# EasyEDA Pro project 第十五届蓝桥杯EDA赛模拟试题二参考答案.eprj, board PCB-PockerMultimater1
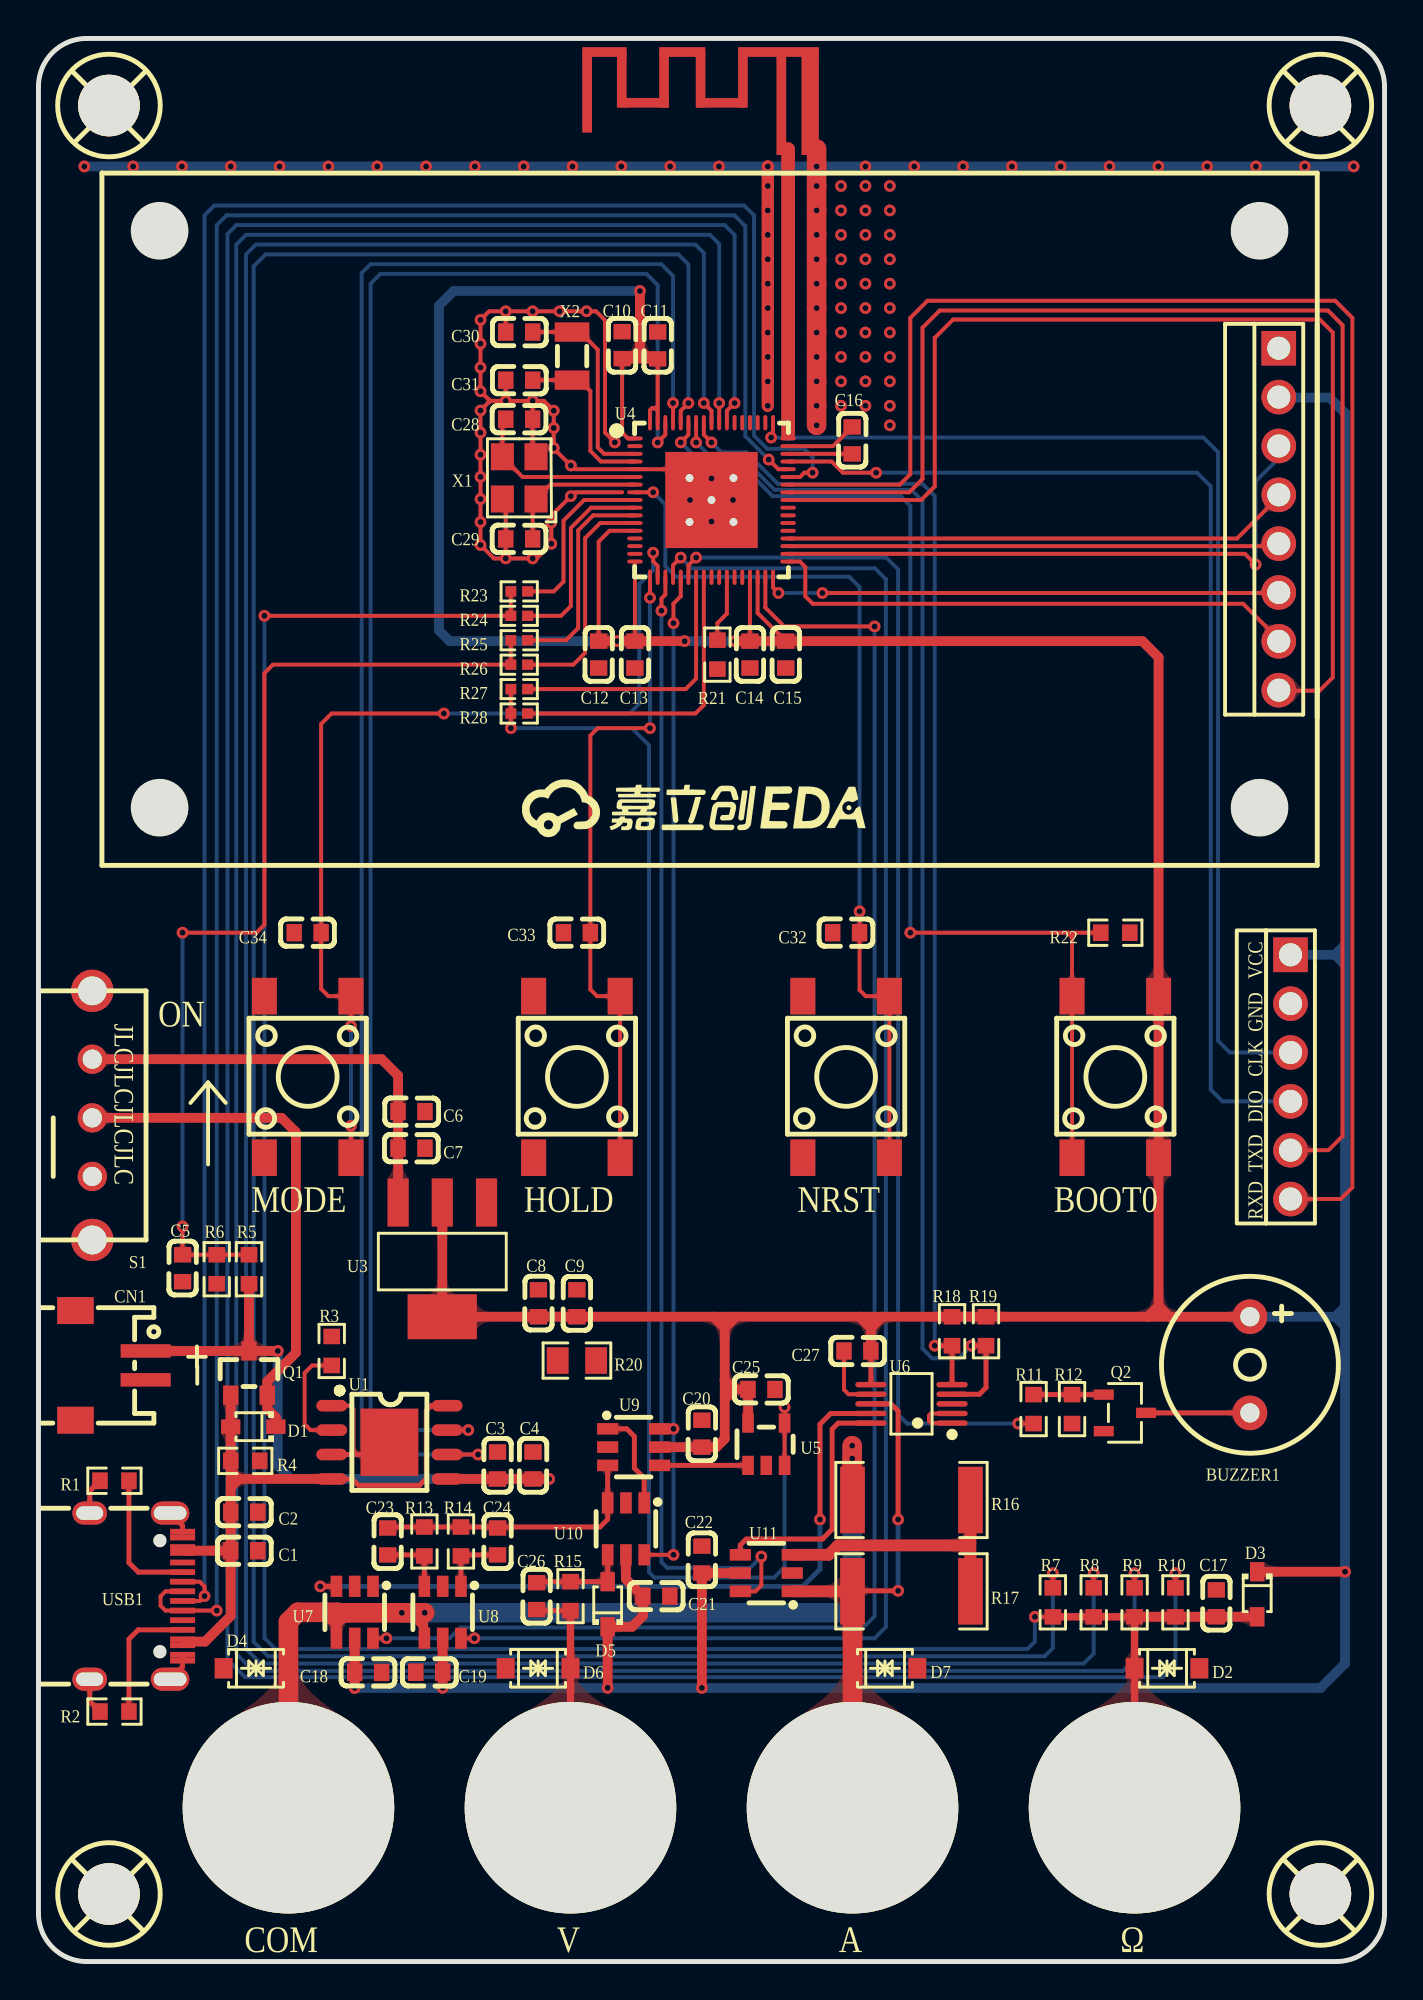
[diagram p1: board, top side]
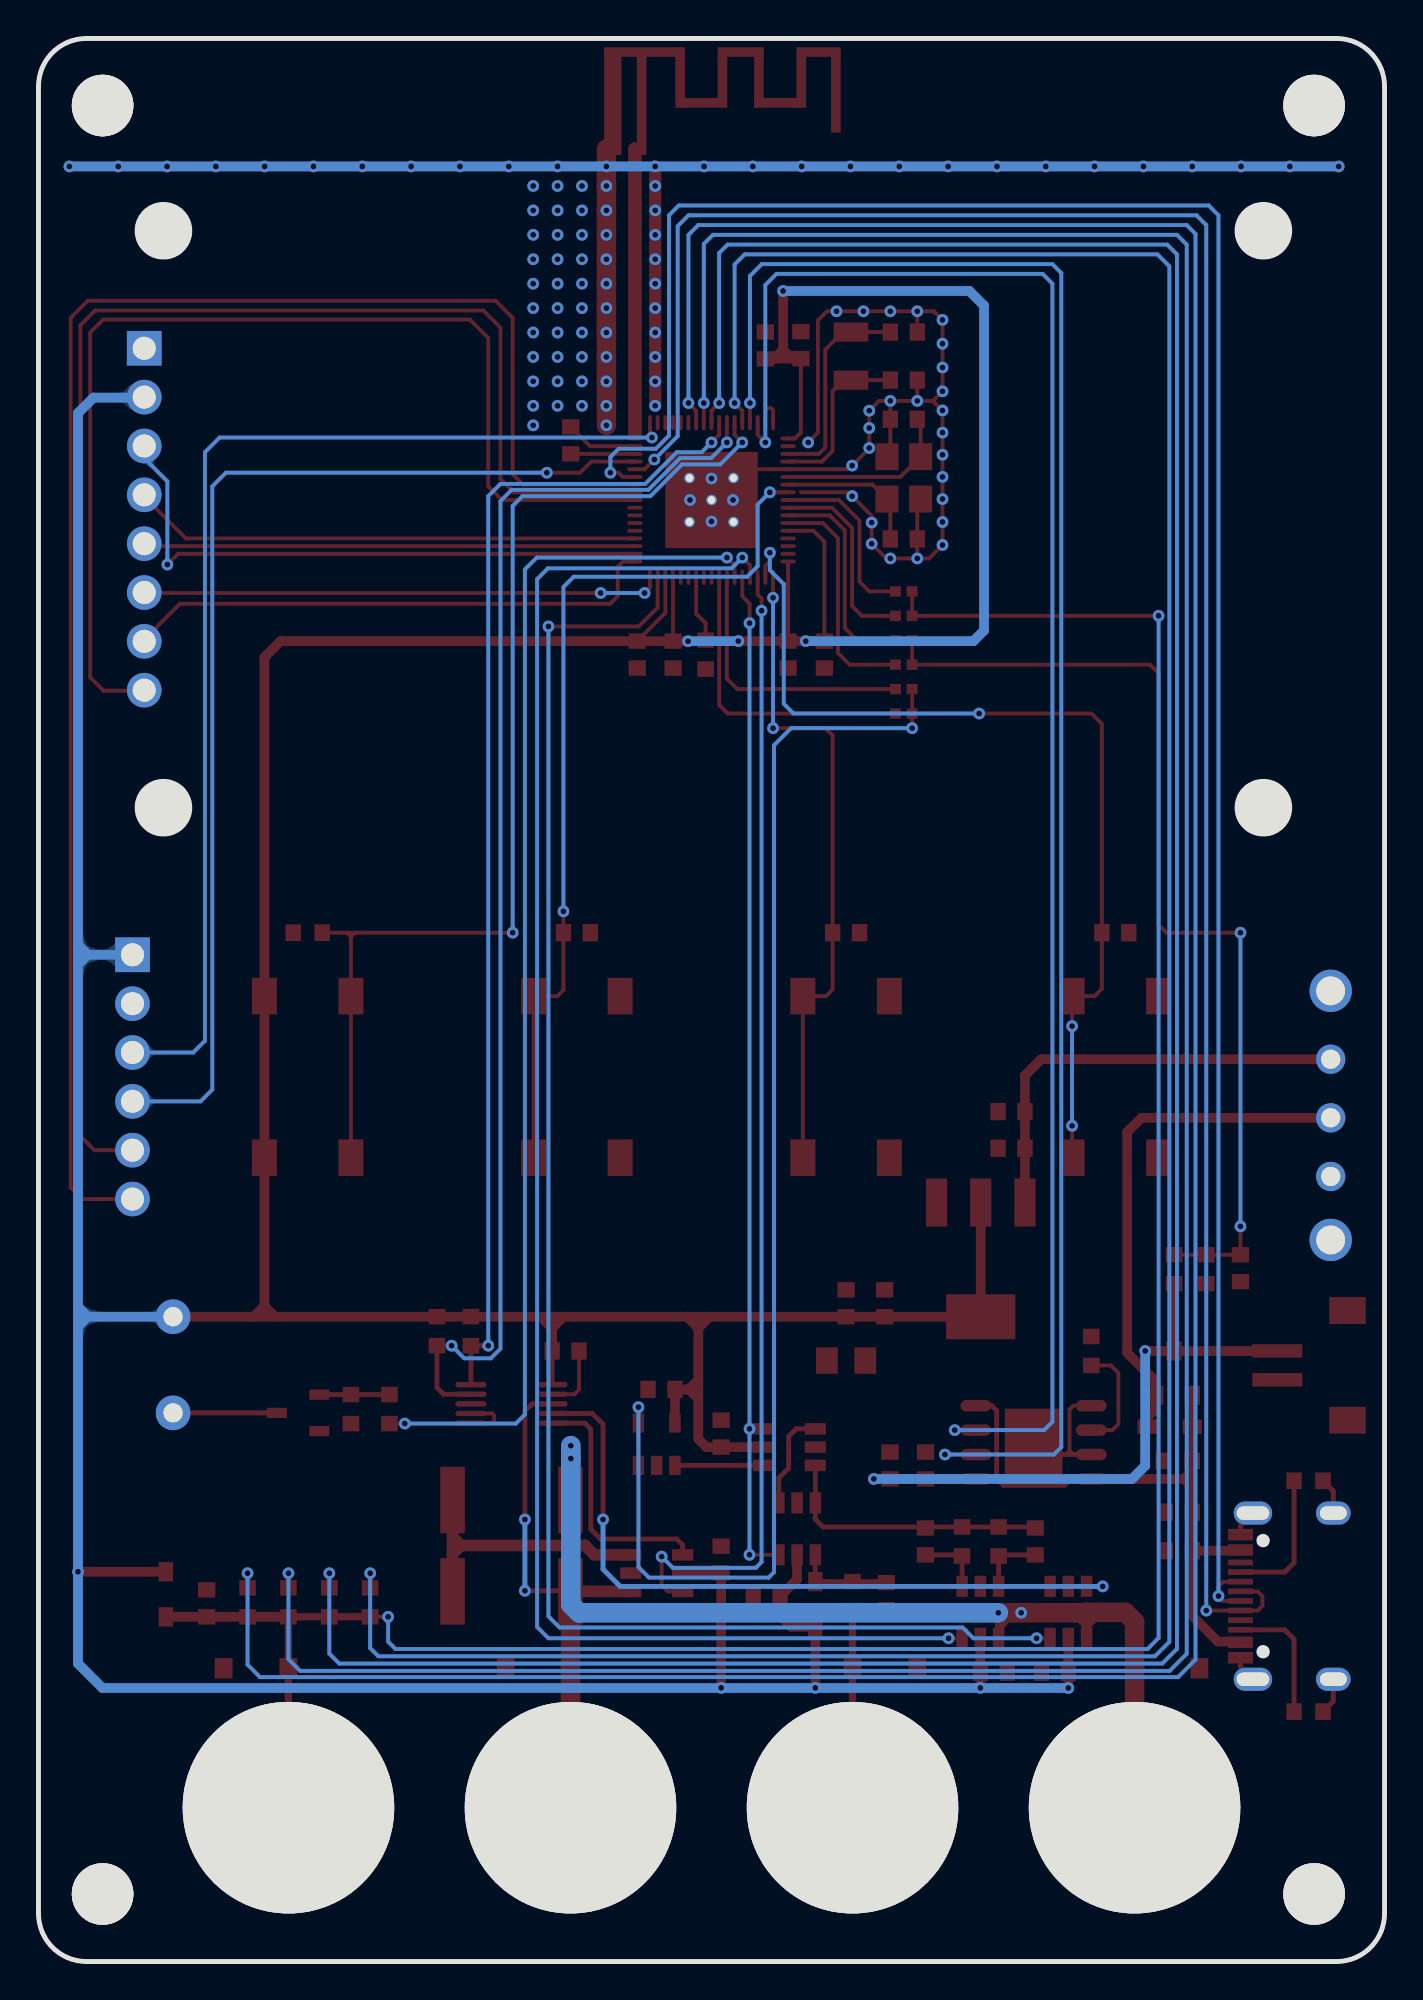
[diagram p2: board, bottom side, seen from below]

Outline 70 x 100 mm; copper layers: Top Layer, Bottom Layer. Coordinates in mm from the lower left corner of the outline.
Outline path: 0,97.5 0,2.5 arc(0.73,0.73) 2.5,0 67.5,0 arc(69.27,0.73) 70,2.5 70,97.5 arc(69.27,99.27) 67.5,100 2.5,100 arc(0.73,99.27) 0,97.5
Stack: Top Layer 0.035mm / Dielectric1 1.51mm FR4 er 4.5 / Bottom Layer 0.035mm

## Design rules (mm)
template: 自定义配置
spacing copperThickness1oz (default): track to track 0.102, other pairs 0.152 to 0.3
spacing copperThickness2oz: track to track 0.203, other pairs 0.152 to 0.3
spacing ANT: track to track 0.152, other pairs 0 to 0.3
track width copperThickness1oz (default): min 0.127, default 0.254, max 2.54
track width copperThickness2oz: min 0.203, default 0.254, max 2.54
differential pair differentialPair (default): width min 0.127, default 0.254, max 2.54; gap min 0.152, default 0.152
via viaSize (default): diameter min 0.5, default 0.61, max 10; hole min 0.3, default 0.305, max 6.299
region e1432 uses ANT

## Placement (name value [footprint] x y rotation side)
BUZZER1  3kHz  [BUZ-TH_BD9.0-P5.00-D0.6-FD]  63 31.03 270 top
C1  10uF  [C0603]  10.7 21.36 180 top
C2  100nF  [C0603]  10.7 23.37 180 top
C3  10uF  [C0603]  23.87 25.79 270 top
C4  100nF  [C0603]  25.72 25.79 270 top
C5  100nF  [C0603]  7.49 36.05 270 top
C6  10uF  [C0603]  19.4 44.2 180 top
C7  100nF  [C0603]  19.4 42.29 0 top
C8  10uF  [C0603]  26 34.23 270 top
C9  100nF  [C0603]  28 34.23 90 top
C10  100nF  [C0603]  30.35 84.05 90 top
C11  100nF  [C0603]  32.2 84.04 270 top
C12  100nF  [C0603]  29.13 67.96 270 top
C13  100nF  [C0603]  31.02 67.96 270 top
C14  100nF  [C0603]  37 67.96 270 top
C15  100nF  [C0603]  38.86 67.96 270 top
C16  1uF  [C0603]  42.32 79.1 270 top
C17  100nF  [C0603]  61.25 18.62 270 top
C18  100nF  [C0603]  17.14 15.03 0 top
C19  100nF  [C0603]  20.32 15.04 180 top
C20  100nF  [C0603]  34.5 27.45 90 top
C21  100nF  [C0603]  32.13 19 0 top
C22  100nF  [C0603]  34.5 20.9 90 top
C23  100nF  [C0603]  18.16 21.84 90 top
C24  100nF  [C0603]  23.88 21.84 90 top
C25  100nF  [C0603]  37.6 29.75 0 top
C26  100nF  [C0603]  25.91 19 90 top
C27  100nF  [C0603]  42.59 31.75 180 top
C28  12pF  [C0603]  25 80.2 0 top
C29  12pF  [C0603]  25 73.98 0 top
C30  12pF  [C0603]  25 84.73 180 top
C31  12pF  [C0603]  25 82.23 180 top
C32  100nF  [C0603]  42 53.5 0 top
C33  100nF  [C0603]  28 53.5 0 top
C34  100nF  [C0603]  14 53.5 0 top
CN1  1.5K-BH-2PWB  [CONN-SMD_2P-P1.50_HDGC_1.5K-BH-2PWB]  3.75 31 270 top
D1  1N5819WS  [SOD-323_L1.8-W1.3-LS2.5-RD]  11.17 27.81 180 top
D2  SJD12C40L01  [SOD-123_L2.8-W1.8-LS3.7-BI]  58.69 15.25 180 top
D3  1N4148  [SOD-323_L1.8-W1.3-LS2.5-RD]  63.38 19.1 270 top
D4  SJD12C40L01  [SOD-123_L2.8-W1.8-LS3.7-BI]  11.31 15.25 0 top
D5  1N4148  [SOD-323_L1.8-W1.3-LS2.5-RD]  29.6 18.58 90 top
D6  SJD12C40L01  [SOD-123_L2.8-W1.8-LS3.7-BI]  25.98 15.25 0 top
D7  SJD12C40L01  [SOD-123_L2.8-W1.8-LS3.7-BI]  44.02 15.25 180 top
E1  b447b6ded30549a1bc5f3c75f00ffb42  [ANT-F-1-2.4G-1.6]  38.98 94.25 0 top
H1  -  [M3]  3.5 96.5 0 top
H2  -  [M3]  66.5 96.5 0 top
H3  -  [M3]  3.5 3.5 0 top
H4  -  [M3]  66.5 3.5 0 top
H5  2.54-1x6P直针  [HDR-TH_6P-P2.54-V-M-1]  65.11 46 270 top
J1  -  [香蕉头-4mm-24.302.*]  13 8 0 top
J2  -  [香蕉头-4mm-24.302.*]  27.67 8 0 top
J3  -  [香蕉头-4mm-24.302.*]  42.33 8 0 top
J4  -  [香蕉头-4mm-24.302.*]  57 8 0 top
Q1  AO3401A  [SOT-23_L2.9-W1.3-P1.90-LS2.4-BR]  10.95 30.6 270 top
Q2  S8050  [SOT-23-3_L3.0-W1.7-P0.95-LS2.9-BR]  56.5 28.53 180 top
R1  5.1kΩ  [R0603]  3.95 25 0 top
R2  5.1kΩ  [R0603]  3.95 13 0 top
R3  10kΩ  [R0603]  15.25 31.75 270 top
R4  10kΩ  [R0603]  10.75 26.03 180 top
R5  10kΩ  [R0603]  10.95 36 270 top
R6  10kΩ  [R0603]  9.27 36 90 top
R7  1kΩ  [R0603]  52.75 18.68 90 top
R8  10kΩ  [R0603]  54.88 18.68 90 top
R9  100kΩ  [R0603]  57 18.68 90 top
R10  1MΩ  [R0603]  59.13 18.68 90 top
R11  10kΩ  [R0603]  51.75 28.73 270 top
R12  10kΩ  [R0603]  53.75 28.73 90 top
R13  100kΩ  [R0603]  20.07 21.84 90 top
R14  1MΩ  [R0603]  21.97 21.84 90 top
R15  1MΩ  [R0603]  27.67 19 90 top
R16  10mΩ  [R2512]  45.4 24 180 top
R17  80mΩ  [R2512]  45.4 19.25 0 top
R18  4.7kΩ  [R0603]  47.51 32.78 90 top
R19  4.7kΩ  [R0603]  49.28 32.78 90 top
R20  0Ω  [R0805]  28 31.25 180 top
R21  10kΩ  [R0603]  35.31 67.96 270 top
R22  10kΩ  [R0603]  56 53.5 0 top
R23  0Ω  [R0402]  25 71.25 0 top
R24  0Ω  [R0402]  25 69.98 0 top
R25  0Ω  [R0402]  25 68.71 0 top
R26  0Ω  [R0402]  25 67.44 0 top
R27  0Ω  [R0402]  25 66.17 0 top
R28  0Ω  [R0402]  25 64.9 0 top
S1  SK-12E12-G5  [SW-TH_SK-12E12-G5]  2.8 44 180 top
SW1  TS-1002S-07026C  [KEY-SMD_4P-L6.0-W6.0-P4.50-LS9.0]  56 46 270 top
SW2  TS-1002S-07026C  [KEY-SMD_4P-L6.0-W6.0-P4.50-LS9.0]  42 46 270 top
SW3  TS-1002S-07026C  [KEY-SMD_4P-L6.0-W6.0-P4.50-LS9.0]  28 46 270 top
SW4  TS-1002S-07026C  [KEY-SMD_4P-L6.0-W6.0-P4.50-LS9.0]  14 46 270 top
U1  TP4056X-42-ESOP8  [SOP-8_L4.9-W3.9-P1.27-LS6.0-TL-EP]  18.25 27 0 top
U2  -  [2.0寸TFT屏幕模块-8Pin]  35 75 270 top
U3  AMS1117-3.3  [SOT-223-3_L6.5-W3.4-P2.30-LS7.0-BR]  21 36.5 90 top
U4  06357c805a7e473a9e139561b596cbda  [QFN68(8x8)]  35 76 270 top
U5  -  [SOT-23-5_L2.9-W1.6-P0.95-LS2.8-BL]  37.85 26.9 0 top
U6  INA226AIDGSR  [MSOP-10_L3.0-W3.0-P0.50-LS5.0-BL]  45.4 29 90 top
U7  SN74LVC1G3157DBVR  [SOT-23-6_L2.9-W1.6-P0.95-LS2.8-BR]  16.44 18.16 90 top
U8  SN74LVC1G3157DBVR  [SOT-23-6_L2.9-W1.6-P0.95-LS2.8-BR]  21.02 18.16 90 top
U9  SN74LVC1G3157DBVR  [SOT-23-6_L2.9-W1.6-P0.95-LS2.8-BR]  30.95 26.75 180 top
U10  SN74LVC1G3157DBVR  [SOT-23-6_L2.9-W1.6-P0.95-LS2.8-BR]  30.55 22.5 90 top
U11  SN74LVC1G3157DBVR  [SOT-23-6_L2.9-W1.6-P0.95-LS2.8-BR]  37.85 20.2 0 top
USB1  KH-TYPE-C-16P  [USB-C-SMD_KH-TYPE-C-16P]  5.08 19 270 top
X1  32MHz  [OSC-SMD_4P-L3.2-W2.5-BL]  25 77.15 90 top
X2  32.768kHz  [FC-135R_L3.2-W1.5]  27.75 83.48 90 top

## Footprints (pads in the part's own frame, mm; a bottom-side part is the same pattern mirrored in y, then rotated)
2.0寸TFT屏幕模块-8Pin
  rect 1.8x1.8 hole 1.2: 1(-8.89,29.5)
  round 1.8 hole 1.2: 2(-6.35,29.5) 3(-3.81,29.5) 4(-1.27,29.5) 5(1.27,29.5) 6(3.81,29.5) 7(6.35,29.5) 8(8.89,29.5)
ANT-F-1-2.4G-1.6
  rect 0.8x0.6 smd: 0(1.143,0)
  rect 0.4x0.6 smd: 1(-0.34,0)
BUZ-TH_BD9.0-P5.00-D0.6-FD
  round 1.8 hole 1: 1(-2.5,0) 2(2.5,0)
C0603
  rect 0.8x0.9 smd: 1(-0.7,0) 2(0.7,0)
CONN-SMD_2P-P1.50_HDGC_1.5K-BH-2PWB
  rect 0.7x2.6 smd: 1(-0.75,1.825) 2(0.75,1.825)
  rect 1.4x1.9 smd: 3(2.85,-1.825) 4(-2.85,-1.825)
FC-135R_L3.2-W1.5
  rect 1x1.8 smd: 1(-1.25,0) 2(1.25,0)
HDR-TH_6P-P2.54-V-M-1
  rect 1.8x1.8 hole 1.2: 1(-6.35,0)
  round 1.8 hole 1.2: 2(-3.81,0) 3(-1.27,0) 4(1.27,0) 5(3.81,0) 6(6.35,0)
KEY-SMD_4P-L6.0-W6.0-P4.50-LS9.0
  rect 1.9x1.3 smd: 1(-4.2,2.25) 2(4.2,2.25) 3(-4.2,-2.25) 4(4.2,-2.25)
M3
  round 3.2 hole 3.2: 0(0.165,0.013)
MSOP-10_L3.0-W3.0-P0.50-LS5.0-BL
  oval 0.28x1.62 smd: 1(-1,-2.11) 2(-0.5,-2.11) 3(0,-2.11) 4(0.5,-2.11) 5(1,-2.11) 6(1,2.11) 7(0.5,2.11) 8(0,2.11) 9(-0.5,2.11) 10(-1,2.11)
OSC-SMD_4P-L3.2-W2.5-BL
  rect 1.4x1.2 smd: 1(-1.1,-0.875) 2(1.1,-0.875) 3(1.1,0.875) 4(-1.1,0.875)
QFN68(8x8)
  round 0.559 hole 0.406: 0(-1.143,1.143) 0(-1.143,-1.143) 0(0,0) 0(1.143,1.143) 0(1.143,-1.143)
  rect 5x4.8 smd: 0(0,0)
  oval 0.2x0.8 smd: 1(-3.2,-3.982) 2(-2.8,-3.982) 3(-2.4,-3.982) 4(-2,-3.982) 5(-1.6,-3.982) 6(-1.2,-3.982) 7(-0.8,-3.982) 8(-0.4,-3.982) 9(0,-3.982) 10(0.4,-3.982) 11(0.8,-3.982) 12(1.2,-3.982) 13(1.6,-3.982) 14(2,-3.982) 15(2.4,-3.982) 16(2.8,-3.982) 17(3.2,-3.982) 35(3.2,3.982) 36(2.8,3.982) 37(2.4,3.982) 38(2,3.982) 39(1.6,3.982) 40(1.2,3.982) 41(0.8,3.982) 42(0.4,3.982) 43(0,3.982) 44(-0.4,3.982) 45(-0.8,3.982) 46(-1.2,3.982) 47(-1.6,3.982) 48(-2,3.982) 49(-2.4,3.982) 50(-2.8,3.982) 51(-3.2,3.982)
  oval 0.8x0.2 smd: 18(4.018,-3.2) 19(4.018,-2.8) 20(4.018,-2.4) 21(4.018,-2) 22(4.018,-1.6) 23(4.018,-1.2) 24(4.018,-0.8) 25(4.018,-0.4) 26(4.018,0) 27(4.018,0.4) 28(4.018,0.8) 29(4.018,1.2) 30(4.018,1.6) 31(4.018,2) 32(4.018,2.4) 33(4.018,2.8) 34(4.018,3.2) 52(-4.018,3.2) 53(-4.018,2.8) 54(-4.018,2.4) 55(-4.018,2) 56(-4.018,1.6) 57(-4.018,1.2) 58(-4.018,0.8) 59(-4.018,0.4) 60(-4.018,0) 61(-4.018,-0.4) 62(-4.018,-0.8) 63(-4.018,-1.2) 64(-4.018,-1.6) 65(-4.018,-2) 66(-4.018,-2.4) 67(-4.018,-2.8) 68(-4.018,-3.2)
R0402
  rect 0.566x0.54 smd: 1(-0.433,0) 2(0.433,0)
R0603
  rect 0.806x0.864 smd: 1(-0.753,0) 2(0.753,0)
R0805
  rect 1.133x1.377 smd: 1(-1,0) 2(1,0)
R2512
  rect 1.282x3.456 smd: 1(-3.067,0) 2(3.067,0)
SOD-123_L2.8-W1.8-LS3.7-BI
  rect 0.93x1.06 smd: 1(1.685,0) 2(-1.685,0)
SOD-323_L1.8-W1.3-LS2.5-RD
  rect 1x0.75 smd: 1(-1.173,0) 2(1.173,0)
SOP-8_L4.9-W3.9-P1.27-LS6.0-TL-EP
  oval 1.6x0.6 smd: 1(-3,1.905) 2(-3,0.635) 3(-3,-0.635) 4(-3,-1.905) 5(3,-1.905) 6(3,-0.635) 7(3,0.635) 8(3,1.905)
  rect 3x3.5 smd: 9(0,0)
SOT-23-3_L3.0-W1.7-P0.95-LS2.9-BR
  rect 1.038x0.532 smd: 1(1.101,-0.95) 2(1.101,0.95) 3(-1.101,0)
SOT-23-5_L2.9-W1.6-P0.95-LS2.8-BL
  rect 0.6x1 smd: 1(-0.95,-1.1) 2(0,-1.1) 3(0.95,-1.1) 4(0.95,1.1) 5(-0.95,1.1)
SOT-23-6_L2.9-W1.6-P0.95-LS2.8-BR
  rect 1.1x0.6 smd: 1(1.35,-0.95) 2(1.35,0) 3(1.35,0.95) 4(-1.35,0.95) 5(-1.35,0) 6(-1.35,-0.95)
SOT-23_L2.9-W1.3-P1.90-LS2.4-BR
  rect 1x0.8 smd: 1(1.15,-0.95) 2(1.15,0.95) 3(-1.15,0)
SOT-223-3_L6.5-W3.4-P2.30-LS7.0-BR
  rect 2.5x1.1 smd: 1(2.97,-2.3) 2(2.97,0) 3(2.97,2.3)
  rect 2.34x3.6 smd: 4(-2.97,0)
SW-TH_SK-12E12-G5
  round 1.524 hole 1: 1(0,3.175) 2(0,0.127) 3(0,-2.921)
  round 2.2 hole 1.5: 4(0,-6.477) 5(0,6.477)
USB-C-SMD_KH-TYPE-C-16P
  oval 1.2x2 hole 0.7x1.7: 1(-4.32,1.765) 2(4.32,1.765)
  oval 1.2x1.8 hole 0.7x1.4: 3(-4.32,-2.415) 4(4.32,-2.415)
  rect 0.3x1.3 smd: A1(-3.35,2.415) A4(-2.55,2.415) A5(-1.25,2.415) A6(-0.25,2.415) A7(0.25,2.415) A8(1.25,2.415) A9(2.55,2.415) A12(3.35,2.415) B1(3.05,2.415) B4(2.25,2.415) B5(1.75,2.415) B6(0.75,2.415) B7(-0.75,2.415) B8(-1.75,2.415) B9(-2.25,2.415) B12(-3.05,2.415)
香蕉头-4mm-24.302.*
  round 11 hole 12.2x6.1: 1(0,0)

## Nets
As in the schematic, except:
3V3: BUZZER1.1 C8.2 C9.1 C10.1 C11.2 C12.1 C13.1 C14.1 C15.1 C18.1 C19.1 C20.1 C21.1 C22.1 C25.1 C27.1 D3.1 D5.1 H5.1 R18.2 R19.2 SW1.1 SW1.2 U2.2 U3.2 U3.4 U4.1 U4.13 U4.17 U4.31 U4.32 U4.67 U4.68 U5.5 U6.6 U7.5 U8.5 U9.5 U10.5 U11.5
AGND: C17.1 C18.2 C19.2 C20.2 C21.2 C22.2 C25.2 C27.2 D2.2 D4.2 D6.2 D7.2 R20.1 U5.2 U6.1 U6.2 U6.7 U7.1 U7.2 U8.2 U9.2 U10.2 U11.2
ADC_VOLTAGE: R27.1 R28.1 U5.3 U5.4
$1N6482: U5.1 U9.4

Pads without a net: E1 0; H1 0; H2 0; H3 0; H4 0; S1 1; U4 2 14 15 16 26 27 29 30 39 40 41 42 53 54 55 56 57; U6 3; USB1 A8 B8

## Via types
v1: diameter 0.61, hole 0.305, Top Layer to Bottom Layer, 181 vias

## Routing (per net, layer and track width the routed paths; a pad name or vN(x,y) marks a point on that pad's centre or on a via; arc(x,y) is an arc through that point)
3V3: length 360.3
  Top Layer w0.203: U4.67 32.2,80.65 ; 32.2,80.65 32.2,80.9 ; 32.2,80.65 32.08,80.77 ; U4.13 29.7,74.4 29.13,73.83 C12.1 ; C10.1 30.35,79.5 30.66,79.2 U4.1 ; 32.2,80.9 32.08,80.77 ; 32.2,80.9 C11.2 ; 32.08,80.77 31.9,80.77 31.8,80.67 U4.68 ; C15.1 37.4,70.12 U4.32 ; U4.17 C13.1 ; U4.31 C14.1
  Top Layer w0.254: C27.1 43.29,30
  Top Layer w0.508: U3.2 U3.4 C8.2 C9.1 35.1,33.53 ; v1(34.5,14.23) C22.1 U11.5 ; C27.1 43.29,32.93 ; 43.29,32.93 42.69,33.53 ; 43.29,32.93 43.89,33.53 ; 31.74,83.35 32.18,83.35 C11.2 ; 31.74,83.35 31.28,83.82 ; 31.74,83.35 30.81,83.35 ; 35.1,33.53 36.28,33.53 ; 35.1,33.53 35.69,32.94 ; v1(21.02,14.23) C19.1 U8.5 ; U5.5 C25.1 36.18,29.75 ; 31.28,83.82 30.81,83.35 ; 31.28,83.82 v1(31.28,86.87) ; 35.69,30.24 35.69,27.18 35.26,26.75 C20.1 U9.5 ; 35.69,30.24 35.69,32.94 ; 35.69,30.24 35.69,30.24 36.18,29.75 ; U10.5 30.55,19.88 C21.1 31.43,17.97 30.87,17.41 D5.1 v1(29.6,14.23) ; 42.69,33.53 36.28,33.53 ; 42.69,33.53 43.89,33.53 ; 43.89,33.53 R18.2 R19.2 57.69,33.53 ; 30.81,83.35 C10.1 ; 36.18,29.75 35.69,29.26 ; v1(67.94,20.27) D3.1 ; v1(16.44,14.22) C18.1 U7.5 ; 58.81,33.53 57.69,33.53 ; 58.81,33.53 BUZZER1.1 ; 58.81,33.53 58.25,34.09 ; 57.69,33.53 58.25,34.09 ; 58.25,34.09 SW1.2 SW1.1 58.25,67.82 57.41,68.66 C15.1 C14.1 37,68.66 v1(36.22,68.66) ; 35.69,32.94 36.28,33.53 ; v1(33.6,68.66) C13.1 v1(30.1,68.66) C12.1
  Bottom Layer w0.508: 67.81,52.35 67.42,52.35 ; 67.42,52.35 67.94,52.87 ; 67.42,52.35 H5.1 ; 67.42,52.35 67.94,51.83 ; 67.94,52.87 67.94,51.83 ; 67.94,52.87 67.94,80.52 67.14,81.32 65.11,81.32 ; 67.94,51.83 67.94,33.02 ; v1(16.44,14.22) 66.68,14.22 67.94,15.49 v1(67.94,20.27) 67.94,33.02 ; 67.43,33.53 67.94,34.04 ; 67.43,33.53 67.94,33.02 ; 67.43,33.53 BUZZER1.1 ; v1(33.6,68.66) 36.22,68.66 v1(36.22,68.66) ; v1(30.1,68.66) 21.38,68.66 20.83,69.22 20.83,86.11 21.59,86.87 v1(31.28,86.87)
+5V: length 27
  Top Layer w0.508: D1.1 12.34,28.29 11.9,28.73 Q1.2 11.9,30.17 13.39,31.65 13.39,43.13 12.64,43.87 S1.2
AGND: length 6.3
  Top Layer w0.203: C27.2 41.89,29.74 42.13,29.5 U6.7 ; U6.1 46.42,28 46.31,28.11 46.31,28.4 46.41,28.5 U6.2
GND: length 166.9
  Top Layer w0.203: 16.59,26.37 16.38,26.57 ; 16.38,26.57 16.38,28.7 16.18,28.91 U1.1 ; 16.38,26.57 16.18,26.37 ; 27.9,77.6 U4.5 33.4,77.6 U4.0 ; 23.49,81.15 v1(24.3,81.15) ; 23.49,81.15 v1(22.99,81.65) v1(22.99,82.89) v1(22.99,85.36) 23.44,85.81 v1(24.3,85.81) ; 23.49,81.15 v1(22.99,80.65) v1(22.99,79.5) v1(22.99,78.35) v1(22.99,77.2) v1(22.99,76.05) v1(22.99,74.86) v1(22.99,73.66) 23.69,72.96 v1(24.3,72.96) ; v1(24.3,81.15) C31.2 ; v1(24.3,81.15) v1(25.7,81.15) ; USB1.B12 USB1.A1 ; v1(25.7,81.15) C28.2 25.7,78.42 X1.2 ; v1(25.7,81.15) 26.29,81.15 v1(26.8,80.64) v1(26.8,79.74) v1(26.8,78.7) 26.8,78.68 v1(27.69,77.79) ; U4.49 C16.2 ; v1(26.67,74.83) 26.67,75.18 v1(27.69,76.2) 27.89,76.4 30.35,76.4 ; v1(24.3,85.81) C30.2 ; v1(24.3,85.81) v1(25.7,85.81) v1(27.1,85.81) v1(28.5,85.81) 29,85.81 29.46,85.34 29.46,79.5 v1(29.97,78.99) ; 26.8,74.83 26.67,74.7 v1(26.67,73.72) 25.91,72.96 v1(24.3,72.96) ; v1(24.3,72.96) C29.1 24.3,75.88 X1.4
  Top Layer w0.254: USB1.B1 USB1.A12 7.5,15.33 USB1.2 ; USB1.4 2.67,13.53 R2.1 ; USB1.A1 7.5,22.67 USB1.1 ; U1.9 17.61,26.37 U1.3 ; USB1.3 2.67,24.47 R1.1
  Top Layer w0.635: v1(37.93,80.9) v1(37.93,82.17) v1(37.93,83.44) v1(37.93,84.71) v1(37.93,85.98) v1(37.93,87.25) v1(37.93,88.52) v1(37.93,89.79) v1(37.93,91.06) v1(37.93,92.33) v1(37.93,93.34)
  Top Layer w1.016: 40.47,94.25 v1(40.47,93.34) v1(40.47,92.33) v1(40.47,91.06) v1(40.47,89.79) v1(40.47,88.52) v1(40.47,87.25) v1(40.47,85.98) v1(40.47,84.71) v1(40.47,83.44) v1(40.47,82.17) v1(40.47,80.9) v1(40.47,79.88)
  Bottom Layer w0.508: v1(68.39,93.34) v1(65.85,93.34) v1(63.31,93.34) v1(60.78,93.34) v1(58.24,93.34) v1(55.7,93.34) v1(53.16,93.34) v1(50.62,93.34) v1(48.08,93.34) v1(45.54,93.34) v1(43,93.34) v1(40.47,93.34) v1(37.93,93.34) v1(35.39,93.34) v1(32.85,93.34) v1(30.31,93.34) v1(27.77,93.34) v1(25.23,93.34) v1(22.69,93.34) v1(20.16,93.34) v1(17.62,93.34) v1(15.08,93.34) v1(12.54,93.34) v1(10,93.34) v1(7.46,93.34) v1(4.92,93.34) v1(2.39,93.34)
  vias: v1(22.99,84.13) v1(25.7,72.96) v1(33.88,76) v1(35,77.12) v1(35,74.88) v1(36.12,76) v1(41.74,92.33) v1(41.74,91.06) v1(41.74,89.79) v1(41.74,88.52) v1(41.74,87.25) v1(41.74,85.98) v1(41.74,84.71) v1(41.74,83.44) v1(41.74,82.17) v1(41.74,80.9) v1(43,92.33) v1(43,91.06) v1(43,89.79) v1(43,88.52) v1(43,87.25) v1(43,85.98) v1(43,84.71) v1(43,83.44) v1(43,82.17) v1(43,80.9) v1(44.27,92.33) v1(44.27,91.06) v1(44.27,89.79) v1(44.27,88.52) v1(44.27,87.25) v1(44.27,85.98) v1(44.27,84.71) v1(44.27,83.44) v1(44.27,82.17) v1(44.27,80.9) v1(44.27,79.88)
VBAT: length 36
  Top Layer w0.508: CN1.1 Q1.3 ; Q1.3 R5.2 ; Q1.3 v1(12.45,31.75) ; v1(26.56,25.09) C4.2 C3.2 U1.5
  Bottom Layer w0.508: v1(26.56,25.09) 13.13,25.09 12.45,25.78 v1(12.45,31.75)
VBUS: length 32.6
  Top Layer w0.254: U1.8 20.42,28.91 20.17,28.65 20.17,25.12 19.81,24.76 16.64,24.76 16.31,25.09 U1.4
  Top Layer w0.508: 10,25.52 R4.2 D1.2 Q1.1 ; 10,25.52 10,24.67 ; 10,25.52 10.42,25.09 ; 10,24.67 C2.2 C1.2 ; 10,24.67 10.42,25.09 ; 7.68,21.36 C1.2 ; C1.2 10,17.97 8.66,16.64 7.68,16.64 ; 10.42,25.09 U1.4
VIN: length 27.7
  Top Layer w0.254: U6.8 44.33,29 44.7,28.63 v1(44.7,22.99) ; v1(44.7,19.28) 42.41,19.28
  Top Layer w0.61: 42.41,19.28 42.39,19.3 R17.1 U11.1
  Top Layer w1.016: D7.1 J3.1 ; R17.1 42.33,15.25
  Bottom Layer w0.254: v1(44.7,19.28) v1(44.7,22.99)
VINTA: length 3.7
  Top Layer w0.203: C16.1 41.32,78.8 U4.50
ADC_VBAT: length 52
  Top Layer w0.203: 10.95,36.75 C5.1 v1(7.49,38.23) ; v1(7.49,53.5) 11.34,53.5 11.75,53.91 11.75,67 12.19,67.44 R26.1 R25.1
  Bottom Layer w0.203: v1(7.49,53.5) v1(7.49,38.23)
ADC_VOLTAGE: length 71.3
  Top Layer w0.203: R27.1 R28.1 v1(24.57,64.14) ; v1(38.8,28.83) U5.4 U5.3
  Bottom Layer w0.203: v1(38.8,28.83) 38.8,20.51 38.25,19.96 32.03,19.96 31.75,20.24 31.75,63.25 30.86,64.14 v1(24.57,64.14)
ANT: length 14.8
  Top Layer w0.714: 38.98,79.45 38.98,94.25
BOOT0: length 58.7
  Top Layer w0.203: R22.1 53.52,53.5 ; 53.52,53.5 v1(45.34,53.5) ; 53.52,53.5 53.75,53.27 ; v1(33.4,78.99) 33.8,79.39 U4.63 ; 53.75,53.27 SW1.3 SW1.4 ; 53.75,53.27 53.98,53.5
  Bottom Layer w0.203: v1(33.4,78.99) 34.54,77.85 36.53,77.85 38.18,76.2 44.83,76.2 45.34,75.69 v1(45.34,53.5)
BOOT1: length 3.5
  Top Layer w0.203: R21.1 35.31,69.6 35.8,70.09 U4.28
BUZZER: length 63.1
  Top Layer w0.203: v1(34.2,73.01) 33.8,72.61 U4.23 ; 50.93,27.97 R11.2
  Bottom Layer w0.203: 50.93,27.97 45.18,27.97 44.7,28.45 44.7,72.39 44.09,73.01 v1(34.2,73.01)
  vias: v1(50.95,27.97)
CC1: length 7.3
  Top Layer w0.254: USB1.A5 5.19,20.25 4.7,20.74 R1.2
CC2: length 6.8
  Top Layer w0.254: USB1.B5 5.19,17.25 4.7,16.76 R2.2
CHRG: length 90.3
  Top Layer w0.203: U1.7 v1(22.35,27.63) ; U4.66 32.6,79.39 v1(32.2,78.99)
  Bottom Layer w0.203: v1(32.2,78.99) 32.2,87.18 31.62,87.76 17.78,87.76 17.27,87.25 17.27,28.07 17.7,27.63 v1(22.35,27.63)
HOLD: length 34.4
  Top Layer w0.203: U4.18 v1(31.8,70.92) ; v1(31.8,64.14) 29.08,64.14 28.7,63.75 C33.2 28.7,50.55 29.05,50.2 SW3.1 SW3.2
  Bottom Layer w0.203: v1(31.8,64.14) v1(31.8,70.92)
INA_SCL: length 61.1
  Top Layer w0.203: v1(35,78.99) 34.6,79.39 U4.61
  Top Layer w0.254: U6.5 R18.1 v1(46.61,32.02)
  Bottom Layer w0.203: v1(46.61,32.02) 46.61,76.2 45.97,76.83 38.45,76.83 36.8,78.49 35.51,78.49 v1(35,78.99)
INA_SDA: length 66
  Top Layer w0.203: v1(48.51,32.02) R19.1 ; v1(34.2,78.99) U4.62
  Top Layer w0.254: R19.1 49.28,29.84 48.93,29.5 U6.4
  Bottom Layer w0.203: v1(34.2,78.99) 35.01,78.18 36.63,78.18 38.28,76.53 45.39,76.53 45.97,75.95 45.97,31.87 46.47,31.37 47.86,31.37 v1(48.51,32.02)
LCD_BLK: length 57.4
  Top Layer w0.203: U4.43 45.9,76 46.61,76.71 46.61,84.43 47.56,85.38 66.64,85.38 67.31,84.71 67.31,66.77 66.62,66.08 65.11,66.08
LCD_CS: length 28.2
  Top Layer w0.203: 64.6,68.65 62.65,70.6 40.27,70.61 39.88,70.99 39.88,72.52 39.59,72.8 U4.35
LCD_DC: length 27.1
  Top Layer w0.203: U4.34 38.2,71.44 v1(38.48,71.16) ; v1(40.77,71.16) 64.57,71.16 64.6,71.19
  Bottom Layer w0.203: v1(38.48,71.16) v1(40.77,71.16)
LCD_RES: length 25.6
  Top Layer w0.203: 64.57,73.7 64.47,73.6 U4.37
LCD_SCL: length 31.4
  Top Layer w0.203: U4.36 62.74,73.2 v1(63.3,72.64)
  Bottom Layer w0.203: 65.11,78.78 63.3,76.97 v1(63.3,72.64)
LCD_SDA: length 26.6
  Top Layer w0.203: 64.6,76.27 62.33,74 U4.38
LINK_RX: length 82.9
  Top Layer w0.203: H5.5 67.08,42.19 67.82,42.93 67.82,85.09 67.06,85.85 46.86,85.85 45.97,84.96 45.97,77.09 45.28,76.4 U4.44
LINK_TX: length 87.1
  Top Layer w0.203: U4.45 44.8,76.8 45.34,77.34 45.34,85.47 46.23,86.36 67.44,86.36 68.33,85.47 68.33,40.26 67.72,39.65 H5.6
MODE: length 50.2
  Top Layer w0.203: U4.19 32.2,72.58 31.97,72.81 v1(31.97,73.26) ; 16.25,41.9 v1(16.25,43.46) ; v1(21.08,64.9) 15.24,64.9 14.7,64.36 C34.2 14.7,50.58 15.08,50.2 SW4.1 v1(16.25,48.64)
  Bottom Layer w0.203: 31.97,73.15 31.97,72.35 31.24,71.63 31.24,65.41 30.73,64.9 v1(21.08,64.9) ; v1(16.25,43.46) v1(16.25,48.64)
NRST: length 46.6
  Top Layer w0.203: U4.8 v1(31.97,76.4) ; v1(42.7,54.61) C32.2 42.7,50.52 43.02,50.2 SW2.1 SW2.2
  Bottom Layer w0.203: v1(31.97,76.4) 32.6,75.77 32.6,72.56 33.15,72.01 42.16,72.01 42.7,71.47 v1(42.7,54.61)
OSC32IN: length 10.9
  Top Layer w0.203: C30.1 X2.2 28.17,84.73 29.08,83.82 29.08,78.73 29.41,78.4 U4.3
OSC32OUT: length 9.1
  Top Layer w0.203: C31.1 X2.1 28,81.98 ; 27.75,81.98 28,81.98 ; 28,81.98 28.38,81.98 28.7,81.66 28.7,78.55 29.25,78 U4.4
OSC_IN: length 9.4
  Top Layer w0.203: U4.6 25.18,77.2 X1.3 24.12,80.03 C28.1
OSC_OUT: length 7.6
  Top Layer w0.203: C29.2 25.7,75.88 X1.1 26.62,76.8 U4.7
REF: length 37.6
  Top Layer w0.254: v1(40.64,22.99) 40.64,27.94 41.2,28.5 U6.9 ; v1(14.66,19.51) 15.49,19.51 15.5,19.51
  Bottom Layer w0.254: v1(40.64,22.99) 40.64,20.4 39.75,19.51 14.66,19.51
RES: length 130.5
  Top Layer w0.203: v1(11.75,69.98) R24.1 R23.1 ; v1(51.82,17.93) R7.1
  Top Layer w0.381: J4.1 D2.1 R9.1 R8.1 R7.1
  Top Layer w0.508: R9.1 R10.1 C17.2 D3.2
  Bottom Layer w0.203: v1(51.82,17.93) 51.82,16.64 51.43,16.25 12.32,16.25 11.75,16.82 v1(11.75,69.98)
RES_1: length 149.7
  Top Layer w0.203: v1(33.8,81.04) 33.4,80.64 U4.64 ; v1(52.75,20.19) R7.2
  Bottom Layer w0.203: v1(52.75,20.19) 52.75,16.3 52.32,15.88 11.94,15.88 11.19,16.62 11.19,88.15 11.81,88.77 33.27,88.77 33.8,88.25 v1(33.8,81.04)
RES_2: length 155.3
  Top Layer w0.203: v1(34.6,81.04) 35,80.64 U4.60 ; v1(54.88,20.19) R8.2
  Bottom Layer w0.203: v1(54.88,20.19) 54.88,16.01 54.36,15.49 11.56,15.49 10.8,16.26 10.8,88.77 11.3,89.28 34.16,89.28 34.6,88.84 v1(34.6,81.04)
RES_3: length 160.7
  Top Layer w0.203: v1(57,20.19) R9.2 ; v1(35.4,81.04) U4.59
  Bottom Layer w0.203: v1(35.4,81.04) 35.4,89.31 34.93,89.79 10.8,89.79 10.29,89.28 10.29,16 11.18,15.11 56.39,15.11 57,15.72 v1(57,20.19)
RES_4: length 166.3
  Top Layer w0.203: U4.58 35.8,80.64 v1(36.2,81.04) ; v1(59.13,20.19) R10.2
  Bottom Layer w0.203: v1(59.13,20.19) 59.13,15.44 58.48,14.79 10.74,14.79 9.83,15.7 9.83,89.84 10.29,90.3 35.69,90.3 36.2,89.78 v1(36.2,81.04)
SEL_CURRENT: length 59.6
  Top Layer w0.203: U11.6 37.28,19.25 37.59,19.56 v1(37.59,21.06) ; v1(32.4,70.24) 32.4,70.88 32.6,71.08 U4.20
  Bottom Layer w0.203: v1(37.59,21.06) 37.01,20.47 32.7,20.47 32.4,20.77 v1(32.4,70.24)
SEL_OF: length 85.7
  Top Layer w0.203: v1(43.48,69.42) 38.78,69.42 37.8,70.4 U4.33 ; U7.6 v1(18.1,16.81)
  Bottom Layer w0.203: v1(18.1,16.81) 21.38,16.81 21.94,17.37 42.9,17.37 43.48,17.95 v1(43.48,69.42)
SEL_VOLTAGE_0: length 89.2
  Top Layer w0.203: U4.21 33,72.61 v1(33.4,73.01) ; U8.6 v1(22.67,16.81)
  Bottom Layer w0.203: v1(33.4,73.01) 33.96,72.45 43.5,72.45 44.07,71.88 44.07,17.4 43.48,16.81 v1(22.67,16.81)
SEL_VOLTAGE_1: length 53.2
  Top Layer w0.203: U9.6 v1(33.02,27.7) ; U4.22 33.4,70.99 33.02,70.61 33.02,69.6 ; U10.6 v1(33.02,21.15)
  Bottom Layer w0.203: v1(33.02,21.15) v1(33.02,27.7) 33.02,69.6 33.02,69.6
  vias: v1(33.02,69.6)
STDBY: length 93.1
  Top Layer w0.203: v1(33,81.04) U4.65 ; U1.6 v1(22.86,26.37)
  Bottom Layer w0.203: v1(33,81.04) 33,87.65 32.38,88.27 17.27,88.27 16.81,87.8 16.81,26.75 17.2,26.37 v1(22.86,26.37)
SWCLK: length 59
  Top Layer w0.203: v1(38.1,79.25) 38.2,79.35 U4.52
  Bottom Layer w0.203: v1(38.1,79.25) 60.58,79.25 61.34,78.49 61.34,47.88 61.95,47.27 H5.3
SWDIO: length 58.3
  Top Layer w0.203: U4.48 41.25,78 41.83,77.42 v1(43.56,77.42)
  Bottom Layer w0.203: v1(43.56,77.42) 60.25,77.42 60.96,76.71 60.96,45.34 61.57,44.73 H5.4
USB1DM: length 120.9
  Top Layer w0.203: USB1.B7 8.39,19.75 8.64,19.5 8.64,19 8.39,18.75 USB1.A7 ; v1(40.26,77.42) 39.83,77.42 39.61,77.2 U4.46
  Bottom Layer w0.203: v1(8.64,19) 8.64,90.81 9.14,91.31 36.7,91.31 37.21,90.81 37.21,79.35 37.89,78.66 39.83,78.66 40.26,78.23 v1(40.26,77.42)
USB1DP: length 118.6
  Top Layer w0.203: v1(9.27,18.25) USB1.B6 6.6,18.25 6.35,18.5 6.35,19 6.6,19.25 USB1.A6 ; U4.47 38.48,77.6 v1(37.97,78.11)
  Bottom Layer w0.203: v1(9.27,18.25) 9.27,90.3 9.78,90.81 36.19,90.81 36.76,90.24 36.76,79.32 v1(37.97,78.11)
$1N2724: length 5.8
  Top Layer w0.203: R3.2 14.23,31 13.84,30.61 13.84,27.94 14.15,27.63 U1.2
$1N6474: length 3.6
  Top Layer w0.254: Q2.1 R12.2 R11.1
$1N6475: length 5.4
  Top Layer w0.254: Q2.3 63,28.53
$1N6482: length 4.6
  Top Layer w0.254: U9.4 U5.1
$1N6484: length 15
  Top Layer w0.61: U11.3 41.09,21.15 41.58,21.64 48.02,21.64 ; 48.47,22.09 48.47,21.19 ; 48.47,22.09 R16.1 ; 48.47,22.09 48.02,21.64 ; 48.47,21.19 48.02,21.64 ; 48.47,21.19 R17.2
$1N6487: length 56.2
  Top Layer w0.381: U8.4 20.07,16.81 20.07,17.35 ; 20.07,17.35 20.07,18.12 v1(20.09,18.14) ; 20.07,17.35 19.28,18.14 ; 15.5,17.42 14.76,18.16
  Top Layer w0.508: 15.5,17.54 15.5,16.81 ; 15.5,17.54 16.09,18.14 ; 15.5,17.54 15.5,18.11 15.54,18.16
  Top Layer w1.016: R16.2 42.32,24.02 v1(42.32,26.16) v1(42.32,26.82) ; J1.1 D4.1 13,17.67 13.49,18.16 15.54,18.16 15.57,18.14 v1(18.9,18.14) v1(20.09,18.14)
  Bottom Layer w1.016: v1(20.09,18.14) 41.88,18.14 42.32,18.57 v1(42.32,26.16) v1(42.32,26.82)
$1N6488: length 12
  Top Layer w0.254: R15.1 25.96,18.25 C26.1
  Top Layer w0.381: R15.1 D6.1 27.67,8
$1N6489: length 5.1
  Top Layer w0.254: C26.2 25.96,19.75 R15.2 D5.2 U10.4
$1N6490: length 3.5
  Top Layer w0.254: U8.1 R14.1 22.02,21.14 C24.1
$1N6491: length 3.5
  Top Layer w0.254: C23.1 20.02,21.14 R13.1 U8.3
$1N6508: length 14.5
  Top Layer w0.254: 23.82,22.6 R14.2 R13.2 18.21,22.6 C23.2 ; 23.82,22.6 29.2,22.6 29.6,23 U10.3 U9.3 ; 23.82,22.6 C24.2
$1N6517: length 5.2
  Top Layer w0.254: U10.1 31.5,25.14 30.99,25.65 30.99,27.31 30.59,27.7 U9.1
$1N9045: length 13
  Top Layer w0.254: U11.4 36.5,21.66 36.81,21.97 40.77,21.97 41.28,22.48 41.28,27.69 41.59,28 U6.10
$1N10212: length 9.4
  Top Layer w0.203: U4.9 28.38,76 27.31,74.93 27.31,71.75 26.8,71.25 R23.2
$1N10257: length 10.3
  Top Layer w0.203: R24.2 27.18,69.98 27.69,70.48 27.69,74.55 28.74,75.6 U4.10
$1N10302: length 11.3
  Top Layer w0.203: R25.2 27.43,68.71 28.07,69.34 28.07,74.42 28.84,75.2 U4.11
$1N10388: length 12.1
  Top Layer w0.203: U4.12 29.21,74.8 28.43,74.02 28.43,68.05 27.81,67.44 R26.2
$1N10482: length 14.3
  Top Layer w0.203: U4.24 34.2,66.71 33.66,66.17 R27.2
$1N10485: length 16
  Top Layer w0.203: R28.2 34.16,64.9 34.6,65.33 U4.25
$1N25880: length 22.9
  Top Layer w0.508: U3.3 C7.1 C6.2 18.7,46.07 17.85,46.92 S1.3

## Copper pours and planes (outline as drawn; the poured copper is in the pictures)
AGND on Top Layer: 28.07,33.02 49.91,33.02 49.91,24.51 50.67,23.75 70,23.75 70,0 0,0 0,11.79 7.73,11.79 8.64,12.7 8.64,15.88 12.57,19.81 12.57,23.75 27.31,23.75 28.07,24.51
GND on Top Layer: 0,97.5 0.01,97.74 0.06,98.05 0.15,98.35 0.27,98.63 0.43,98.91 0.62,99.15 0.85,99.38 1.09,99.57 1.37,99.73 1.65,99.85 1.95,99.94 2.26,99.99 2.5,100 67.5,100 67.74,99.99 68.05,99.94 68.35,99.85 68.63,99.73 68.91,99.57 69.15,99.38 69.38,99.15 69.57,98.91 69.73,98.63 69.85,98.35 69.94,98.05 69.99,97.74 70,97.5 70,2.5 69.99,2.26 69.94,1.95 69.85,1.65 69.73,1.37 69.57,1.09 69.38,0.85 69.15,0.62 68.91,0.43 68.63,0.27 68.35,0.15 68.05,0.06 67.74,0.01 67.5,0 2.5,0 2.26,0.01 1.95,0.06 1.65,0.15 1.37,0.27 1.09,0.43 0.85,0.62 0.62,0.85 0.43,1.09 0.27,1.37 0.15,1.65 0.06,1.95 0.01,2.26 0,2.5

Small or netless copper shapes (teardrops, artwork), in the pictures only: 413 on Top Layer, 68 on Bottom Layer

## Text on the board
Top Silkscreen Layer: + | - | VCC | GND | CLK | DIO | TXD | RXD | JLCJLCJLCJLC | COM | MODE | HOLD | V | NRST | A | BOOT0 | Ω | ON | ↑
